# EasyEDA Pro project 效果器12-18.eprj, board PCB1 (continued)
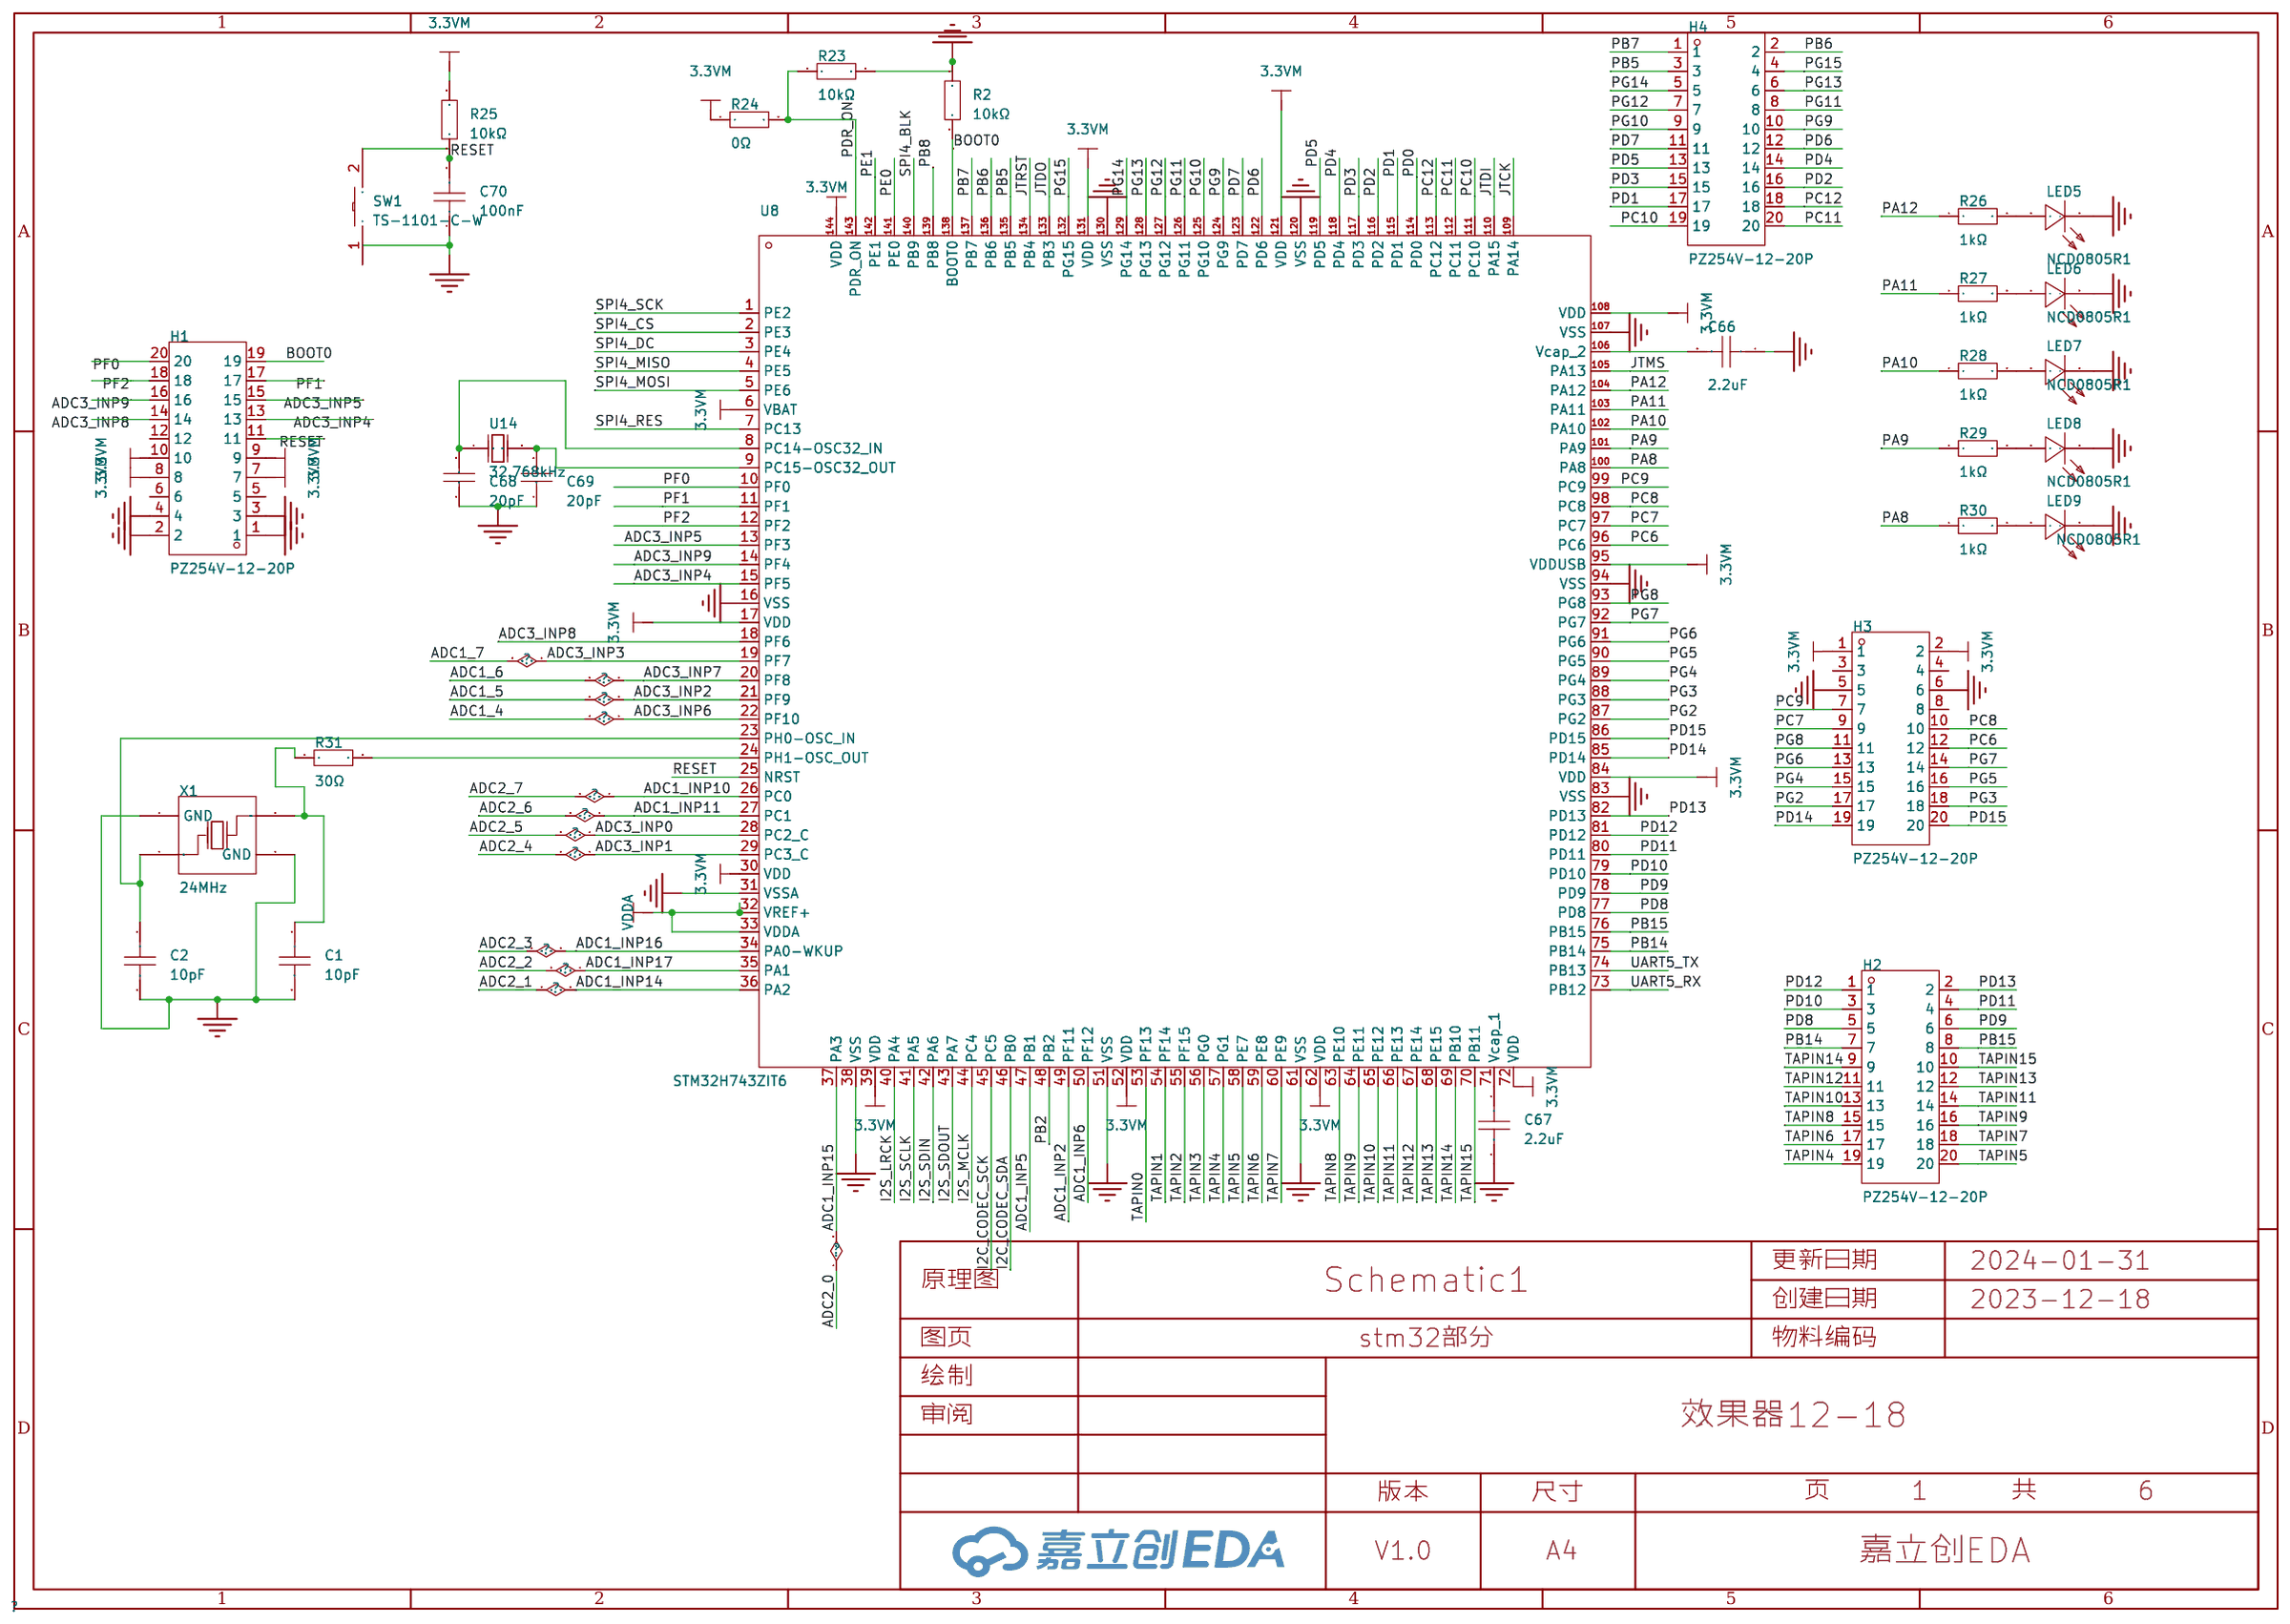
[diagram p0: stm32部分]
## Routing (per net, layer and track width the routed paths; a pad name or vN(x,y) marks a point on that pad's centre or on a via; arc(x,y) is an arc through that point) (continued)
  vias: v1(45.21,33.53) v1(45.52,34.14) v1(45.83,33.53) v1(47.75,28.7) v1(47.75,28.07) v1(48.39,28.7) v1(48.39,28.07) v1(49.04,28.7) v1(49.05,28.07)
3.3V_NOB: length 43.8
  Top Layer w0.127: U11.4 8.97,30.56 R21.2
  Top Layer w0.508: U11.2 14.06,37.48 C47.2
  Top Layer w1.016: U11.4 U11.2 ; 13.33,30.61 20.93,30.61 C48.1
  Top Layer w1.27: AD1_INF7.3 7.37,16.64 5.97,18.03 5.97,23.62 12.83,30.48
3.3VA: length 46.5
  Top Layer w0.127: R19.2 32.5,38.73 30.79,38.73 C12.2 ; 46.3,48.14 46.61,48.14
  Top Layer w0.254: 46.11,47.64 46.7,48.22 47.24,48.22 47.28,48.26 U6.31 ; 46.11,47.64 C34.2 ; 46.11,47.64 46.08,47.6
  Top Layer w0.508: v1(48.01,45.72) 47.82,45.9 C33.2 46.14,47.54 C34.2 ; C12.2 30.06,38.32 31.5,39.75 32.26,39.75 v1(34.04,41.53)
  Top Layer w0.762: C12.2 30.06,35.43 U5.2 29.73,33.54 29.72,33.53 ; U5.4 37.22,29.16 C13.1
  Bottom Layer w0.508: v1(48.01,45.72) 48.13,45.59 48.13,42.8 46.86,41.53 v1(34.04,41.53)
  vias: v1(29.32,33.5) v1(29.34,30.73) v1(29.73,33.1) v1(29.73,31.38) v1(30.11,33.5) v1(30.1,30.73)
+5V: length 87
  Top Layer w0.254: F2.1 34.77,58.22 R22.2 ; U6.26 47.92,50.76 47.62,51.05 47.62,51.93 C29.2
  Top Layer w0.508: 42.5,38.6 42.5,37.59 43.22,36.87 U3.3 ; F2.1 34.64,57.56 36.07,56.13 37.47,56.13 41.26,52.33 C28.2 46.9,52.33 C29.2
  Top Layer w1.016: U11.3 11.16,36.88 C46.2 10.54,40.14 10.54,41.4 11.3,42.16 26.67,42.16 26.8,42.29 ; 26.8,42.29 28.86,44.35 34.64,44.35 ; 26.8,42.29 26.8,38.35 C11.2 27.14,35.39 U5.3 ; 34.64,44.35 34.64,43.46 38.48,39.62 42.04,39.62 42.55,39.12 42.55,38.61 ; 34.64,44.35 34.64,57.56
AGND: length 5.8
  Top Layer w0.127: R6.1 45.08,50.54 C30.1 45.37,50.26 46.1,49.53 47.76,49.53 47.99,49.76 U6.28
GND: length 136.5
  Top Layer w0.127: v1(72.52,42.04) 72.77,42.29 72.77,45.09 72.01,45.85 C2.2 ; 67.17,44.7 67.1,44.63 ; 67.1,44.63 66.68,44.21 66.68,41.4 67.44,40.64 69.09,40.64 69.22,40.51 71.5,40.51 v1(71.75,40.77) ; 67.1,44.63 67.06,44.68 67.06,45.14 67.31,45.39 67.31,45.47 68.33,46.48 70.61,46.48 C2.2 ; 76.07,46.99 75.44,46.99 73.03,49.4 73.03,49.66 73.3,49.93 C69.1 74.2,51.19 C68.1 75.05,51.19 75.18,51.05 75.95,51.05 77.85,49.15 77.85,47.24 ; X1.4 70.39,44.64 X1.2 70.35,44.96 C2.2 ; C21.1 67.82,30.87 69.32,32.36 U8.38
  Top Layer w0.254: U8.130 88.39,42.23 v1(88.39,41.28) ; v1(76.07,28.83) 75,28.83 U8.51 73.09,26.93 C24.1 ; U8.16 76.82,41.91 v1(77.72,41.91) ; U8.38 70.23,33.26 70.23,33.27 v1(70.36,33.4) ; U6.33 50.9,49.56 49.15,51.31 U6.24 49.15,53.21 48.51,53.85 47.32,53.85 C29.1 ; 51.15,49.26 U6.12 55.1,49.26 C36.1 ; U8.31 71.88,36.25 v1(71.88,36.19) ; U8.107 95.4,33.23 94.96,33.23 v1(94.74,33.02) ; v1(78.61,25.53) 78.61,25.38 77.47,24.23 ; v1(90.17,28.7) 90.74,28.7 U8.94 ; 87.79,23.87 86.91,24.75 v1(86.38,24.75) 86.36,24.77 ; 92.74,39.5 v1(91.46,38.23) 91.44,38.23
  Top Layer w0.381: U6.2 49.65,48.26 U6.33 51.15,49.26 U6.5
  Bottom Layer w0.127: 35.94,21.72 37.54,21.72 C53.2 ; 42.39,21.72 43.67,20.45 C52.2
  Bottom Layer w0.254: C55.2 24.03,9.6 AD2_INF5.1 ; 48.89,21.72 50.45,21.72 C51.2 ; 16.38,21.72 17.65,21.72 C61.2 ; C14.1 81.53,43.33 81.06,42.86 ; AD1_INF0.1 49.56,10.79 C58.2 52.07,9.33 R15.1 ; C59.2 30.47,21.72 29.35,21.72 ; C50.2 56.25,21.72 55.26,21.72 ; 22.86,21.72 23.73,21.72 C60.2 ; AD2_INF7.1 11.29,10.79 C57.2 ; R16.1 39.28,10.2 C63.2 37.5,10.79 AD1_INF1.1 ; AD2_INF6.1 17.69,10.79 C56.2 ; C54.2 30.33,9.82 AD2_INF4.1 ; C64.2 44.71,9.73 R17.1 43.64,10.79 AD1_INF2.1 ; C62.2 11.15,21.72 9.88,21.72 ; AD1_INF3.1 55.58,10.79 C65.2 58.41,8.96 R18.1
  vias: v1(21.84,56.77) v1(22.1,49.28) v1(22.22,58.8) v1(22.52,56.77) v1(24.28,59.9) v1(56.64,52.45) v1(72.64,57.28) v1(73.05,60.2) v1(79.3,40.59) v1(82.17,42.93) v1(89.41,52.2) v1(91.06,51.05) v1(99,29.26) v1(103.12,34.54)
VDDA: length 7.2
  Top Layer w0.254: v1(71.5,35.18) 70.04,36.64 ; 70.04,36.64 U8.33 ; 70.04,36.64 70.39,36.99 70.39,37.03
  Bottom Layer w0.254: v1(71.5,35.18) 71.51,35.18 C27.2 72.39,34.42 C26.2 73.9,33.41 74.92,34.42
+12: length 9.9
  Top Layer w0.508: R3.1 19.79,56.92 20.19,56.52 20.19,55.88 20.57,55.5 20.57,54.23 20.45,54.1 19.55,54.1 U2.5
ADC1_4: length 67.1
  Top Layer w0.127: U8.22 73.03,41.47 73.03,45.34 71.63,46.74 68.14,46.74 65.91,44.51 65.91,39.88 57.66,31.62 42.8,31.62 38.48,27.31 35.69,27.31 32.13,23.75 32.13,21.96 AD1_INF4.2
  Bottom Layer w0.254: C59.1 31.84,19.18 AD1_INF4.2
ADC1_5: length 78.4
  Top Layer w0.127: 22.85,19.18 21.34,20.7 21.34,25.4 22.99,27.05 23.5,27.05 28.45,32 57.53,32 65.53,40 65.53,44.58 65.66,44.58 68.2,47.12 71.63,47.12 73.41,45.34 73.41,41.79 U8.21
  Bottom Layer w0.254: 22.85,19.18 22.89,19.22 C60.1
ADC1_6: length 85.4
  Top Layer w0.127: AD1_INF6.2 14.48,21.08 14.48,23.88 18.16,27.56 23.62,27.56 28.32,32.26 57.28,32.26 65.15,40.13 65.15,44.58 68.07,47.5 71.88,47.5 73.79,45.59 73.79,42.42 74.03,42.17 74.03,41.87 U8.20
  Bottom Layer w0.254: C61.1 16.42,19.14 AD1_INF6.2
ADC1_7: length 89.1
  Top Layer w0.127: 74.99,41.62 74.17,42.45 74.17,45.72 72.14,47.75 67.82,47.75 64.77,44.7 64.77,40.13 57.15,32.51 28.19,32.51 24,28.32 16.64,28.32 11.81,23.5 11.81,21.08 9.91,19.18 9.28,19.18
  Bottom Layer w0.254: AD1_INF7.2 12.6,19.18 C62.1
ADC1_INP10: length 83
  Top Layer w0.127: AD2_INF7.2 11.68,10.06 11.68,11.18 14.48,13.97 28.96,13.97 32.89,17.91 32.89,23.88 35.81,26.8 53.21,26.8 53.59,27.18 53.85,27.18 66.68,40 71.66,40 U8.26
  Bottom Layer w0.254: AD2_INF7.2 10.14,8.51 C57.1
ADC1_INP11: length 75.4
  Top Layer w0.127: AD2_INF6.2 20.07,11.94 20.07,12.32 21.34,13.59 29.84,13.59 33.27,17.02 33.27,23.24 36.19,26.16 53.34,26.16 66.68,39.5 71.46,39.5 U8.27
  Bottom Layer w0.254: C56.1 18.2,8.25 AD2_INF6.2
ADC1_INP14: length 31.3
  Top Layer w0.127: U8.36 68.02,36.58 66.68,36.58 53.72,23.62 51.94,23.62 50.42,22.1 50.42,20.7 AD2_INF1.2
  Bottom Layer w0.254: AD2_INF1.2 49.23,19.52 C51.1
ADC1_INP15: length 25.4
  Top Layer w0.127: U8.37 68.14,31.88 67.31,31.88 66.42,32.77 63.63,32.77 58.93,28.07 58.93,26.42 57.28,24.77 57.28,21.19 AD2_INF0.2
  Bottom Layer w0.254: C50.1 55.55,19.46 AD2_INF0.2
ADC1_INP16: length 45.7
  Top Layer w0.127: AD2_INF3.2 36.7,19.18 37.59,20.07 37.59,21.84 40.39,24.64 53.47,24.64 66.17,37.34 68.67,37.34 U8.34
  Bottom Layer w0.127: C53.1 38.63,19.18 AD2_INF3.2
ADC1_INP17: length 38.3
  Top Layer w0.127: AD2_INF2.2 44.58,21.36 44.58,22.35 46.36,24.13 53.59,24.13 66.42,36.96 68.45,36.96 69.33,36.08 U8.35
  Bottom Layer w0.127: AD2_INF2.2 45.09,19.18 C52.1
ADC2_4: length 63.6
  Top Layer w0.127: 71.46,38.09 70.68,38.86 67.18,38.86 53.47,25.15 36.83,25.15 34.42,22.73 34.42,13.32 AD2_INF4.2
  Bottom Layer w0.254: AD2_INF4.2 31.66,8.25 C54.1
ADC2_5: length 69
  Top Layer w0.127: AD2_INF5.2 22.84,8.87 26.03,12.06 29.84,12.06 33.78,16 33.78,22.99 36.45,25.65 53.47,25.65 66.93,39.12 71.13,39.12 U8.28
  Bottom Layer w0.254: C55.1 25.02,8.25 AD2_INF5.2
ADC3_INP4: length 23.1
  Top Layer w0.127: v1(74.93,43.94) 75.5,43.94 U8.15
  Bottom Layer w0.127: H1.13 72.01,62.94 72.01,48.39 73.66,46.74 73.66,45.21 v1(74.93,43.94)
ADC3_INP5: length 23.2
  Top Layer w0.127: v1(75.31,45.34) 75.52,45.34 U8.13 ; v1(75.44,57.02) 75.44,63.58 H1.15
  Bottom Layer w0.127: v1(75.44,57.02) 72.52,54.1 72.52,49.02 74.68,46.86 74.68,45.97 v1(75.31,45.34)
ADC3_INP8: length 26.5
  Top Layer w0.127: U8.18 74.68,42.64 v1(74.68,43.31)
  Bottom Layer w0.127: v1(74.68,43.31) 71.75,46.23 71.75,63.12 71.37,63.5 71.37,64.85 H1.14
ADC3_INP9: length 27.2
  Top Layer w0.127: v1(75.18,44.58) 75.57,44.58 76.76,43.39
  Bottom Layer w0.127: v1(75.18,44.58) 74.04,45.72 74.04,46.99 72.26,48.77 72.26,55.12 76.45,59.31 76.45,65.1 H1.16
BOOT0: length 79.5
  Top Layer w0.127: 86.38,45.87 86.51,45.87 88.84,48.2 R2.2 87.85,47.88 v1(87.76,47.88) ; v1(81.45,53.55) 80.39,54.61 v1(80.39,57.69) ; v1(71.25,52.58) 71.75,53.09 v1(73.03,53.09)
  Bottom Layer w0.127: v1(73.03,53.09) 75.79,53.09 v1(80.39,57.69) H1.19 ; v1(81.45,53.55) 87.38,47.62 87.5,47.62 v1(87.76,47.88) ; R35.2 47.24,39.24 50.29,42.29 64.13,42.29 64.52,42.67 64.52,45.85 67.82,49.15 67.82,50.04 68.71,50.93 70.99,50.93 71.25,51.18 v1(71.25,52.58)
I2C_CODEC_SCK: length 42.1
  Top Layer w0.127: U6.16 53.41,51.31 54.23,51.31 54.48,51.05 57.28,51.05 57.91,50.42 TEST_PIN.6 ; v1(66.42,24.51) 66.43,24.51 71.81,29.89
  Bottom Layer w0.127: TEST_PIN.6 57.91,36.83 65.91,28.83 65.91,24.77 66.17,24.51 v1(66.42,24.51)
I2C_CODEC_SDA: length 44.7
  Top Layer w0.127: U8.46 68.45,25.82 68.45,24.89 v1(67.56,24) ; TEST_PIN.7 59.18,50.42 57.91,51.69 52.94,51.69 U6.17
  Bottom Layer w0.127: v1(67.56,24) 67.26,24 67.06,24.21 67.06,28.7 59.18,36.58 TEST_PIN.7
I2S_LRCK: length 35.7
  Top Layer w0.127: U6.7 52.15,46.53 52.32,46.36 52.32,41.53 TEST_PIN.1 ; v1(60.2,27.05) 65.44,27.05 U8.40
  Bottom Layer w0.127: v1(60.2,27.05) 51.56,35.69 TEST_PIN.1
I2S_MCLK: length 37.8
  Top Layer w0.127: TEST_PIN.5 56.64,43.05 54.61,45.08 54.61,48.39 54.23,48.76 U6.11 ; v1(65.28,25.02) 66.24,25.02 71.46,30.24
  Bottom Layer w0.127: TEST_PIN.5 56.64,37.08 64.64,29.08 64.64,25.27 64.9,25.02 v1(65.28,25.02)
I2S_SCLK: length 35.4
  Top Layer w0.127: v1(61.47,26.54) 65.64,26.54 U8.41 ; U6.8 52.83,46.87 TEST_PIN.2
  Bottom Layer w0.127: TEST_PIN.2 52.83,36.19 54.61,34.42 54.74,34.42 60.83,28.32 60.83,26.67 60.96,26.54 v1(61.47,26.54)
I2S_SDIN: length 36
  Top Layer w0.127: v1(62.74,26.03) 65.84,26.03 U8.42 ; TEST_PIN.3 54.1,43.69 53.59,44.2 53.59,47.53 U6.9
  Bottom Layer w0.127: v1(62.74,26.03) 62.23,26.03 62.1,26.16 62.1,28.07 54.1,36.07 TEST_PIN.3
I2S_SDOUT: length 36.9
  Top Layer w0.127: U8.43 66.04,25.53 v1(64.01,25.53) ; U6.10 53.37,48.26 53.97,48.26 54.1,48.13 54.1,44.7 55.37,43.43 TEST_PIN.4
  Bottom Layer w0.127: v1(64.01,25.53) 63.63,25.53 63.37,25.78 63.37,27.05 62.48,27.94 62.48,29.97 55.5,36.96 55.5,40.64 TEST_PIN.4
JTCK: length 25.4
  Top Layer w0.127: JTAG1.9 114.81,28.07 114.81,29.59 114.08,30.31 106.03,30.31 R13.1 97.33,35.61 U8.109
JTDI: length 25.8
  Top Layer w0.127: U8.110 97.09,36.78 97.09,37.14 99.57,39.62 100.33,39.62 108.08,31.88 JTAG1.5
  Top Layer w0.254: U8.110 96.27,35.95 95.12,34.8 v1(94.62,34.8)
  Bottom Layer w0.254: R11.1 94.49,34.92 v1(94.62,34.8)
JTDO: length 46.1
  Top Layer w0.127: v1(106.06,33) v1(101.52,37.55) ; v1(86.87,42.67) 87.25,43.05 87.25,43.2 88.14,44.1 88.17,44.1 v1(90.81,46.74)
  Bottom Layer w0.127: v1(90.81,46.74) 92.33,46.74 v1(101.52,37.55) ; v1(106.06,33) 110.62,28.45 110.62,24.64 JTAG1.13 ; v1(86.87,42.67) 85.09,40.89 85.09,40.83 R14.1
JTMS: length 19.8
  Top Layer w0.127: U8.105 98.95,28.27 R12.1 112.47,28.27 JTAG1.7
JTRST: length 40.3
  Top Layer w0.127: v1(86.36,43.18) 86.52,43.18 v1(89.66,46.32) 89.66,46.36 ; v1(107.62,35.12) v1(102.5,40.25)
  Bottom Layer w0.127: v1(107.62,35.12) 108.33,34.42 JTAG1.3 ; 82.12,40.33 83.64,40.33 86.36,43.05 v1(86.36,43.18) ; v1(102.5,40.25) 94.87,47.88 91.06,47.88 89.66,46.48 v1(89.66,46.32)
PA8: length 18.5
  Top Layer w0.127: R30.1 100.2,16.25 100.2,18.42 96.65,21.97 96.65,27.05 93.81,29.89 93.8,29.89
PA9: length 16.1
  Top Layer w0.127: R29.1 100.97,18.04 100.97,19.18 97.41,22.73 97.41,26.98 94.15,30.24
PA10: length 14.4
  Top Layer w0.127: R28.1 102.48,20.2 98.68,24 98.68,26.42 U8.102
PA11: length 12.4
  Top Layer w0.127: U8.103 100.46,25.35 100.46,23.75 102.17,22.04 R27.1
PA12: length 10.2
  Top Layer w0.127: R26.1 101.48,25.03 U8.104
PB5: length 29.2
  Top Layer w0.127: H4.3 107.27,64.64 U8.135
PB6: length 33
  Top Layer w0.127: U8.136 87.08,45.17 107.7,65.79 109.6,65.79 H4.2
PB7: length 30.7
  Top Layer w0.127: U8.137 86.79,45.51 H4.1
PB14: length 20.5
  Top Layer w0.127: U8.75 87,19.01 87,15.24 84.96,13.21 83.52,13.21 H2.7
PB15: length 23.5
  Top Layer w0.127: U8.76 87.38,19.34 87.38,14.73 85.22,12.57 83.82,12.57 77.98,6.73 77.98,5.13 H2.8
PC6: length 27.7
  Top Layer w0.127: 92.39,28.47 94.87,25.99 94.87,20.95 97.92,17.91 97.92,14.35 98.68,13.59 98.68,5.21 H3.12
PC7: length 25.4
  Top Layer w0.127: H3.9 99.95,13.08 98.43,14.61 98.43,18.16 98.3,18.16 95.38,21.08 95.38,26.19 92.74,28.82
PC8: length 29.2
  Top Layer w0.127: U8.98 93.12,29.18 95.76,26.54 95.76,21.34 98.81,18.29 98.81,14.99 101.22,12.57 101.22,5.21 H3.10
PC9: length 26.8
  Top Layer w0.127: U8.99 96.14,26.84 96.14,21.72 99.31,18.54 99.31,15.11 102.11,12.32 102.11,6.86 H3.7
PC10: length 15.9
  Top Layer w0.127: U8.111 96.77,37.17 96.77,37.34 101.35,41.91 106.04,41.91 H4.19
PC11: length 19.5
  Top Layer w0.127: U8.112 101.44,42.55 104.9,42.55 107.82,45.47 109.85,45.47 H4.20
PC12: length 19.9
  Top Layer w0.127: H4.18 109.98,45.85 109.09,45.85 108.97,45.72 107.19,45.72 104.52,43.05 101.22,43.05 95.21,37.05 95.21,37.03
PD1: length 17.7
  Top Layer w0.127: U8.115 103.64,46.86 H4.17
PD2: length 21.5
  Top Layer w0.127: 94.15,38.09 104.07,48.01 109.6,48.01 H4.16
PD3: length 19.2
  Top Layer w0.127: U8.117 104,48.64 104.01,48.64 104.78,49.4 H4.15
PD4: length 23
  Top Layer w0.127: H4.14 109.85,50.8 105.41,50.8 93.45,38.84 U8.118
PD5: length 20.7
  Top Layer w0.127: H4.13 105.89,51.94 U8.119
PD6: length 25
  Top Layer w0.127: U8.122 92.03,40.34 104.52,52.83 106.68,52.83 107.19,53.34 109.6,53.34 109.73,53.47 109.98,53.47 H4.12
PD7: length 22.5
  Top Layer w0.127: H4.11 105.6,54.48 U8.123
PD8: length 20.7
  Top Layer w0.127: H2.5 79.32,7.19 84.2,12.06 84.33,11.94 85.6,11.94 87.88,14.22 87.88,19.54 85.67,21.75
PD9: length 23.9
  Top Layer w0.127: 86.02,22.11 86.1,22.11 88.52,19.69 88.52,13.84 86.11,11.43 84.58,11.43 80.52,7.37 80.52,5.13 H2.6
PD10: length 20.9
  Top Layer w0.127: H2.3 81.86,7.95 84.71,10.79 86.36,10.79 88.9,13.33 88.9,19.94 86.38,22.46
PD11: length 23.7
  Top Layer w0.127: U8.80 86.73,22.75 89.28,20.19 89.28,12.83 87,10.54 85.85,10.54 83.06,7.75 83.06,5.13 H2.4
PD12: length 20.6
  Top Layer w0.127: H2.1 84.4,8.08 85.98,9.65 86.87,9.65 89.79,12.57 89.79,20.46 U8.81
PD13: length 23.6
  Top Layer w0.127: 87.44,23.52 87.48,23.52 90.17,20.83 90.17,12.06 86.87,8.76 85.98,8.76 85.85,8.64 85.85,5.38 H2.2
PD14: length 20.6
  Top Layer w0.127: H3.19 87.25,7.37 90.93,11.05 90.93,22.15 U8.85
PD15: length 23.8
  Top Layer w0.127: U8.86 91.44,22.34 91.44,9.65 88.39,6.6 88.39,5.08 H3.20
PDR_ON: length 7.9
  Top Layer w0.127: R23.1 85.85,49.45 85.85,48.89 84.61,47.65 U8.143 83.82,46.85 83.82,46.61 83.44,46.23 v1(83.44,45.97)
  Bottom Layer w0.254: 82.89,44.29 83.44,44.84 v1(83.44,45.97)
PF0: length 27.9
  Top Layer w0.127: U8.10 76.37,46.61 75.31,46.61 72.26,49.66 72.26,50.55 79.12,57.4 79.12,64.97 H1.20
PF1: length 24.7
  Top Layer w0.127: 77.82,44.45 76.04,46.23 75.18,46.23 71.88,49.53 71.88,50.67 77.85,56.64 H1.17
PF2: length 27.7
  Top Layer w0.127: 77.47,44.1 75.72,45.85 74.93,45.85 71.5,49.28 71.5,50.8 76.58,55.88 76.58,64.97 H1.18
PG2: length 21.1
  Top Layer w0.127: H3.17 89.79,6.99 92.2,9.4 92.2,19.81 91.82,20.19 91.82,22.67 U8.87
PG3: length 24
  Top Layer w0.127: U8.88 92.07,23.12 92.07,20.32 92.46,19.94 92.46,8.64 90.93,7.11 90.93,5.08 H3.18
PG4: length 21.3
  Top Layer w0.127: H3.15 93.22,7.37 93.22,19.69 92.33,20.57 92.33,23.58 U8.89
PG5: length 24.3
  Top Layer w0.127: H3.16 93.6,5.21 93.6,19.94 92.84,20.7 92.84,23.78 U8.90
PG6: length 22
  Top Layer w0.127: U8.91 93.22,24.1 93.22,20.7 94.87,19.05 H3.13
PG7: length 25.8
  Top Layer w0.127: U8.92 91.05,27.06 93.73,24.38 93.73,20.95 96.14,18.54 96.14,5.21 H3.14
PG8: length 23.8
  Top Layer w0.127: U8.93 94.36,24.37 94.36,20.83 97.41,17.78 97.54,17.78 97.54,13.84 97.79,13.59 97.79,6.86 H3.11
PG9: length 26.3
  Top Layer w0.127: H4.10 109.73,55.75 106.3,55.75 105.92,55.37 105.78,55.37 U8.124
PG10: length 24
  Top Layer w0.127: H4.9 107.7,56.26 105.96,56.26 U8.125
PG11: length 27.8
  Top Layer w0.127: H4.8 109.73,58.29 107.31,58.29 94.11,45.08 94.08,45.08 90.62,41.62
PG12: length 25.5
  Top Layer w0.127: U8.127 90.36,41.98 107.95,59.56 H4.7
PG13: length 29.7
  Top Layer w0.127: H4.6 109.73,60.83 107.7,60.83 107.19,60.33 107.19,59.56 89.96,42.33 U8.128
PG14: length 27.2
  Top Layer w0.127: U8.129 89.56,42.69 104.78,57.91 104.78,58.42 H4.5
PG15: length 31.6
  Top Layer w0.127: H4.4 109.73,63.37 107.95,63.37 107.19,62.61 107.19,61.85 90.3,44.96 89.71,44.96 U8.132
RESET: length 134
  Top Layer w0.127: H1.11 70.23,61.14 C70.2 73.71,57.66 R25.1 69.72,52.17 SW1.2 69.72,50.93 v1(68.58,49.78) ; v1(66.42,40.77) 66.93,40.26 72.11,40.26 72.87,39.5 73.02,39.5 74.68,37.85 77.47,37.85 v1(87.76,27.56)
  Bottom Layer w0.127: v1(87.76,27.56) 96.14,19.18 JTAG1.15 ; D4.2 23.37,39.5 25.65,37.21 45.85,37.21 50.55,41.91 62.74,41.91 63.88,40.77 v1(66.42,40.77) 65.53,41.66 65.41,41.66 64.77,42.29 64.77,45.72 68.58,49.53 v1(68.58,49.78)
SPI4_BLK: length 26
  Top Layer w0.127: SPI_SCREEN.8 103.24,64.38 101.85,62.99 101.47,62.99 87.63,49.15 87.63,48.53 U8.140
SPI4_CS: length 27.9
  Top Layer w0.127: U8.2 81.77,46.86 82.3,46.86 82.55,47.12 82.55,47.62 88.14,53.21 88.86,53.21 SPI_SCREEN.7
SPI4_DC: length 34.2
  Top Layer w0.127: U8.3 79.84,48.09 79.84,49.36 80.14,49.66 81.79,49.66 89.53,57.4 89.53,66.29 90.3,67.06 90.42,66.93 96.4,66.93 98.24,65.09
SPI4_MOSI: length 24.6
  Top Layer w0.127: v1(88.52,58.55) 79.25,49.28 79.25,47.27 U8.5
  Bottom Layer w0.127: v1(88.52,58.55) 93.24,63.27 SPI_SCREEN.4
SPI4_RES: length 29.2
  Top Layer w0.127: v1(85.09,56.52) 85.09,56.26 78.42,49.59 78.42,46.68 79.23,45.87
  Bottom Layer w0.127: SPI_SCREEN.5 95.74,62.97 89.41,56.64 85.22,56.64 v1(85.09,56.52)
SPI4_SCK: length 21
  Top Layer w0.127: 81.35,47.99 90.74,57.37 SPI_SCREEN.3
TAPIN0: length 51.6
  Top Layer w0.127: AD1_INF1.2 37.59,10.05 37.59,11.18 40.13,13.72 61.34,13.72 74.64,27.01 U8.53
  Bottom Layer w0.254: 39.75,9.17 39.69,9.11 C63.1 37.25,8.25 AD1_INF1.2
TAPIN1: length 44.1
  Top Layer w0.127: AD1_INF2.2 42.44,8.28 47.5,13.33 61.62,13.33 U8.54
  Bottom Layer w0.254: AD1_INF2.2 44.47,8.25 R17.2 44.85,8.64 C64.1
TAPIN2: length 37.6
  Top Layer w0.127: U8.55 61.95,12.95 54.74,12.95 50.04,8.25 AD1_INF0.2
  Bottom Layer w0.254: AD1_INF0.2 51.01,8.25 C58.1 52.49,8.24 R15.2
TAPIN3: length 31.4
  Top Layer w0.127: U8.56 62.15,12.45 59.31,12.45 57.02,10.16 57.02,9.79 AD1_INF3.2
  Bottom Layer w0.254: R18.2 58.82,7.87 C65.1 57.02,8.25 AD1_INF3.2
TAPIN4: length 25.2
  Top Layer w0.127: U8.57 75.93,25.64 69.09,18.8 69.09,18.54 61.54,11 H2.19
TAPIN5: length 27.8
  Top Layer w0.127: U8.58 69.02,17.91 68.96,17.91 62.48,11.43 62.74,11.18 62.74,5.13 H2.20
TAPIN6: length 23.8
  Top Layer w0.127: H2.17 64.08,12.4 76.62,24.94 U8.59
TAPIN7: length 26.1
  Top Layer w0.127: H2.18 64.26,3.94 65.28,4.95 65.28,12.75 U8.60
TAPIN8: length 22.1
  Top Layer w0.127: H2.15 66.62,12.52 76.81,22.71 77.36,22.71 78.17,23.52
TAPIN9: length 24.2
  Top Layer w0.127: U8.64 67.94,12.59 67.94,5.84 66.62,4.52 H2.16
TAPIN10: length 20.4
  Top Layer w0.127: H2.13 69.34,6.65 69.34,12.95 77.85,21.46 77.85,21.72 78.88,22.75 U8.65
TAPIN11: length 22.7
  Top Layer w0.127: 79.23,22.46 78.23,21.46 78.23,20.95 70.36,13.08 70.36,5.13 H2.14
TAPIN12: length 18.9
  Top Layer w0.127: H2.11 71.7,13.16 78.61,20.07 78.61,21.08 79.59,22.06 79.59,22.11
TAPIN13: length 21.2
  Top Layer w0.127: 79.94,21.75 79.12,20.93 79.12,19.81 72.9,13.59 72.9,5.13 H2.12
TAPIN14: length 17.4
  Top Layer w0.127: H2.9 74.24,13.41 79.5,18.67 79.5,20.61 U8.69
TAPIN15: length 19.8
  Top Layer w0.127: H2.10 75.56,5.26 75.56,13.97 79.88,18.29 79.88,20.28 U8.70
UART5_RX: length 100.8
  Top Layer w0.127: U8.73 86.11,18.49 86.11,16.51 83.82,14.22 v1(82.17,14.22)
  Bottom Layer w0.127: v1(82.17,14.22) 75.82,14.22 68.45,21.59 62.99,21.59 48.51,36.07 25.15,36.07 20.95,40.26 20.95,53.09 24.51,56.64 U20.2
UART5_TX: length 102.1
  Top Layer w0.127: U8.74 86.61,18.69 86.61,16.26 84.07,13.72 79.63,13.72 v1(78.36,14.99)
  Bottom Layer w0.127: U20.3 25.78,57.28 21.34,52.83 21.34,40.64 25.4,36.58 49.02,36.58 62.99,22.61 69.47,22.61 77.09,14.99 v1(78.36,14.99)
$1N724: length 4
  Top Layer w0.127: 68.22,42.09 68.22,43.11 X1.3 68.83,44.58 67.94,45.47
$1N734: length 5.6
  Top Layer w0.127: U8.24 73.22,39.93 72.26,40.89 72.26,41.15 72.01,41.4 71.5,41.4 71.12,41.02 69.29,41.02 R31.2
$1N753: length 5.8
  Top Layer w0.127: C2.1 72.01,43.79 X1.1 72.01,43.02 72.01,41.78 U8.23
$1N2566: length 2.2
  Top Layer w0.127: U8.106 97.34,30.59 C66.2
$1N2628: length 4.9
  Top Layer w0.254: v1(80.77,23.62) 80.77,23.11 81.79,22.1 81.79,21.48 U8.71
  Bottom Layer w0.254: 81.35,24.59 81.03,24.27 81.03,23.88 v1(80.77,23.62)
$1N3081: length 6.7
  Top Layer w0.127: C68.2 75.38,50.41 U14.1 77.22,48.57 77.22,47.18 U8.8
$1N3094: length 6.3
  Top Layer w0.127: U8.9 75.58,48.11 U14.2 74.12,49.51 C69.2
$1N5110: length 2.1
  Top Layer w0.127: LED5.1 106.16,25.03 R26.2
$1N5149: length 2.3
  Top Layer w0.127: LED6.1 105.98,22.04 R27.2
$1N5188: length 2.3
  Top Layer w0.127: 103.99,19.52 106.03,19.52 LED7.1
$1N5227: length 2.9
  Top Layer w0.127: R29.2 106.03,17.27 LED8.1
$1N5266: length 2.8
  Top Layer w0.127: LED9.1 106.02,14.72 R30.2
$2N626: length 1.7
  Top Layer w0.127: U6.27 46.76,50.26
$2N922: length 18.8
  Top Layer w0.127: U6.30 48,48.76 47.88,48.64 47.24,48.64 47.12,48.51 45.08,48.51 v1(44.58,49.02)
  Top Layer w0.381: C31.1 52.43,57.66 50.29,57.66 v1(49.53,56.9)
  Bottom Layer w0.381: v1(44.58,49.02) 44.58,51.94 v1(49.53,56.9)
$2N925: length 12.1
  Top Layer w0.381: CN1.3 38.48,60.2 38.48,60.33 43.18,60.33 CN1.3 47.77,59.01 C31.2
$2N935: length 12.3
  Top Layer w0.381: CN1.2 CN1.2 44.53,62.21 C32.2
$2N949: length 23.4
  Top Layer w0.127: U6.29 47.99,49.26 47.75,49.02 v1(45.59,49.02) ; C32.1 53.97,65.26 v1(53.97,62.99)
  Bottom Layer w0.381: v1(45.59,49.02) 53.97,57.4 v1(53.97,62.99)
$2N1307: length 8.4
  Top Layer w0.254: C36.2 56.35,50.67 54.74,50.67 54.33,50.26 U6.14 U6.13
  Top Layer w0.508: C36.2 57.23,49.8 C35.2 57.23,46.47 R7.2
$2N1631: length 12.8
  Top Layer w0.127: 50.04,45.63 50.15,45.74 50.15,46.48
  Top Layer w0.381: C38.1 v1(47.29,44.92) 49.87,44.92 50.17,45.21 50.17,46.46 50.15,46.48 U6.3
  Bottom Layer w0.381: R39.2 46.48,44.92 v1(47.29,44.92)
$2N1634: length 4.6
  Top Layer w0.381: C38.2 41.03,46.01 LINEIN1.3
$2N1638: length 14.6
  Top Layer w0.381: U6.6 51.65,46.48 51.69,46.44 51.69,44.07 50.93,43.31 v1(46.86,43.31) 45.65,42.09 C37.1
  Bottom Layer w0.381: R38.1 46.67,43.11 v1(46.86,43.31)
$2N1641: length 3.6
  Top Layer w0.381: LINEIN1.1 42.21,43.27 42.29,43.18
$2N1734: length 2.8
  Top Layer w0.127: U6.18 52.15,52.4 53.09,53.34 53.1,53.33 R8.2
$2N11598: length 1.6
  Top Layer w0.381: C75.2 50.65,52.52 U6.21
$2N11640: length 1.3
  Top Layer w0.381: C76.2 50.17,52.56 50.15,52.55 U6.22
$2N12068: length 10.9
  Top Layer w0.381: R41.1 62.36,51.44 63.37,52.45 LINEOUT1.3
  Bottom Layer w0.381: R36.2 63.37,60.12 LINEOUT1.3
$2N12069: length 9.8
  Top Layer w0.381: R41.2 59.19,51.94 58.42,51.94 57.66,52.7 57.66,53.21 56.48,54.39 C75.1
$2N12112: length 9.2
  Top Layer w0.381: R42.2 61.21,53.6 LINEOUT1.1
  Bottom Layer w0.381: LINEOUT1.1 58.29,59.4 R37.2
$2N12113: length 11.1
  Top Layer w0.381: R42.1 59.06,53.09 56.52,55.63 51.4,55.63 C76.1
$4N793: length 12.3
  Top Layer w0.127: 18.03,56.32 17.65,56.7 17.65,57.53
  Top Layer w0.508: R3.2 18.03,62.81 18.03,56.32 U2.4
$4N1079: length 4.9
  Top Layer w0.127: C5.2 20.32,49.98 20.32,50.55 21.72,51.95 U2.1
$4N1267: length 8.5
  Top Layer w0.254: U2.3 21.72,55.87 21.08,56.52 21.08,58.83 R5.2 22.18,62.51 R4.2
$4N1433: length 12.4
  Top Layer w0.254: R4.1 22.62,64.63 23.37,63.88 23.24,63.75 23.24,55.5 D3.2
$4N4463: length 1.9
  Top Layer w0.127: R19.1 LED1.2
$4N4590: length 1.8
  Top Layer w0.127: R20.1 50.86,37.78 LED2.2
$4N4676: length 2.8
  Top Layer w0.127: R21.1 6.11,32.27 LED3.2
$4N4798: length 2.2
  Top Layer w0.254: R22.1 34.77,65.25 34.64,65.38
$6N5826: length 3
  Top Layer w0.127: USB1.3 28.46,59.57 v1(28.32,59.44)
  Bottom Layer w0.127: 28.32,58.12 v1(28.32,59.44)
$6N5830: length 3.1
  Top Layer w0.127: v1(29.46,59.44) 29.46,59.82 29.34,59.94 29.34,60.95 USB1.2
  Bottom Layer w0.127: v1(29.46,59.44) 29.59,59.31 U20.6
$6N6583: length 3.2
  Bottom Layer w0.127: Q1.1 27.37,48.46 R32.1
$6N6635: length 4.3
  Bottom Layer w0.127: R33.2 23.37,46.68 D4.1 25.28,44.48 Q1.3
$6N6759: length 2.3
  Bottom Layer w0.127: U20.13 27.05,50.28 R32.2
$6N6810: length 15.2
  Bottom Layer w0.127: R34.2 26.17,40.14 27.37,41.34 Q1.2 26.42,44.58 26.42,45.21 25.91,45.72 25.91,45.97 25.78,46.1 U20.14
$6N6816: length 2.6
  Bottom Layer w0.127: Q2.1 30.13,38.38 R34.1
$6N6867: length 3.1
  Bottom Layer w0.127: Q2.3 R35.1

## Copper pours and planes (outline as drawn; the poured copper is in the pictures)
3.3V on Top Layer: 44.96,36.96 45.94,36.96 45.94,34.58 44.96,34.58
3.3V on Top Layer: 43.56,31.11 53.72,31.11 53.72,27.43 43.56,27.43
3.3V on Top Layer: 44.97,36.4 46.1,36.4 46.1,33.22 44.97,33.22
3.3V on Top Layer: 112.4,38.35 116.97,38.35 116.97,35.81 112.4,35.81
3.3V on Bottom Layer: 47.5,28.96 49.4,28.96 49.4,27.69 47.5,27.69
3.3V on Bottom Layer: 64.26,67.06 68.71,67.06 68.71,62.74 64.26,62.74
3.3V on Bottom Layer: 44.83,34.48 46.09,34.48 46.09,33.22 44.83,33.22
3.3V on Bottom Layer: 75.69,40.39 89.28,40.39 89.28,27.94 75.69,27.94
3.3V_NOB on Bottom Layer: 6.86,17.65 9.53,17.65 9.53,5.21 6.86,5.21
3.3V_NOB on Bottom Layer: 43.18,17.78 56.64,17.78 56.64,15.49 43.18,15.49
3.3V_NOB on Bottom Layer: 8.51,6.73 56.52,6.73 56.52,4.44 8.51,4.44
3.3V_NOB on Bottom Layer: 8.76,17.78 44.07,17.78 44.07,15.49 8.76,15.49
3.3VA on Top Layer: 28.96,34.16 30.48,34.16 30.48,32.77 28.96,32.77
3.3VA on Top Layer: 27.95,31.62 31.5,31.62 31.5,29.78 27.95,29.78
3.3VA on Bottom Layer: 28.96,33.78 30.5,33.78 30.5,30.35 28.96,30.35
+12V on Top Layer: 1.91,51.96 9.65,51.96 9.65,48.61 1.91,48.61
GND on Top Layer: 0.5,70.13 119.76,70.13 119.76,0.38 0.5,0.38
GND on Bottom Layer: 0,70 119.38,70 119.38,-0.25 0,-0.25
+12 on Top Layer: 0.89,54.38 20.07,54.38 20.07,43.69 0.89,43.69
DCIN on Top Layer: 4.32,57.53 16.38,57.53 16.38,52.32 4.32,52.32
VUSB on Top Layer: 23.88,61.98 32.64,61.98 32.64,56.9 23.88,56.9
$4N1099 on Top Layer: 16.26,53.34 20.07,53.34 20.07,47.75 16.26,47.75
$4N1099 on Top Layer: 16.22,48.29 22.48,48.29 22.48,43.96 16.22,43.96
$4N1433 on Top Layer: 22.48,55.12 30.61,55.12 30.61,44.07 22.48,44.07

Small or netless copper shapes (teardrops, artwork), in the pictures only: 473 on Top Layer, 223 on Bottom Layer

## Text on the board
Top Silkscreen Layer: GND | TAP4 | TAP5 | TAP6 | TAP7 | TAP9 | 3.3V | TAP8 | 3.3v | TAP10 | TAP11 | RESET | ADC3_INP8 | TAP12 | TAP13 | AD3_INP4 | TAPIN14 | TAP15 | ADC3_INP5 | ADC3_INP9 | PB14 | PB15 | PF2 | PF1 | PD9 | PD8 | PF0 | Boot0 | PD10 | PD11 | PD12 | PD13 | PD15 | PD14 | PG2 | PG3 | PG4 | PG5 | PG6 | PG7 | PG8 | PC6 | PC7 | PC8 | pc9 | gnd | PG12 | PG10 | PG14 | PD3 | PD5 | PD1 | PC10 | PD7 | PB7 | PB6 | PG15 | PD6 | PD2 | PC11 | PG11 | PG13 | PD4 | PC12 | PG9 | PB5 | ADC1_INP10 | ADC3_INP3 | ADC1_INP11 | ADC3_INP7 | ADC3_INP0 | ADC3_INP1 | ADC1_INP16 | TAP0 | ADC1_INP17 | TAP1 | ADC1_INP14 | TAP2 | ADC1_INP15 | TAP3
